# EasyEDA Pro project Chessboards.epro, board Diagonal (continued)
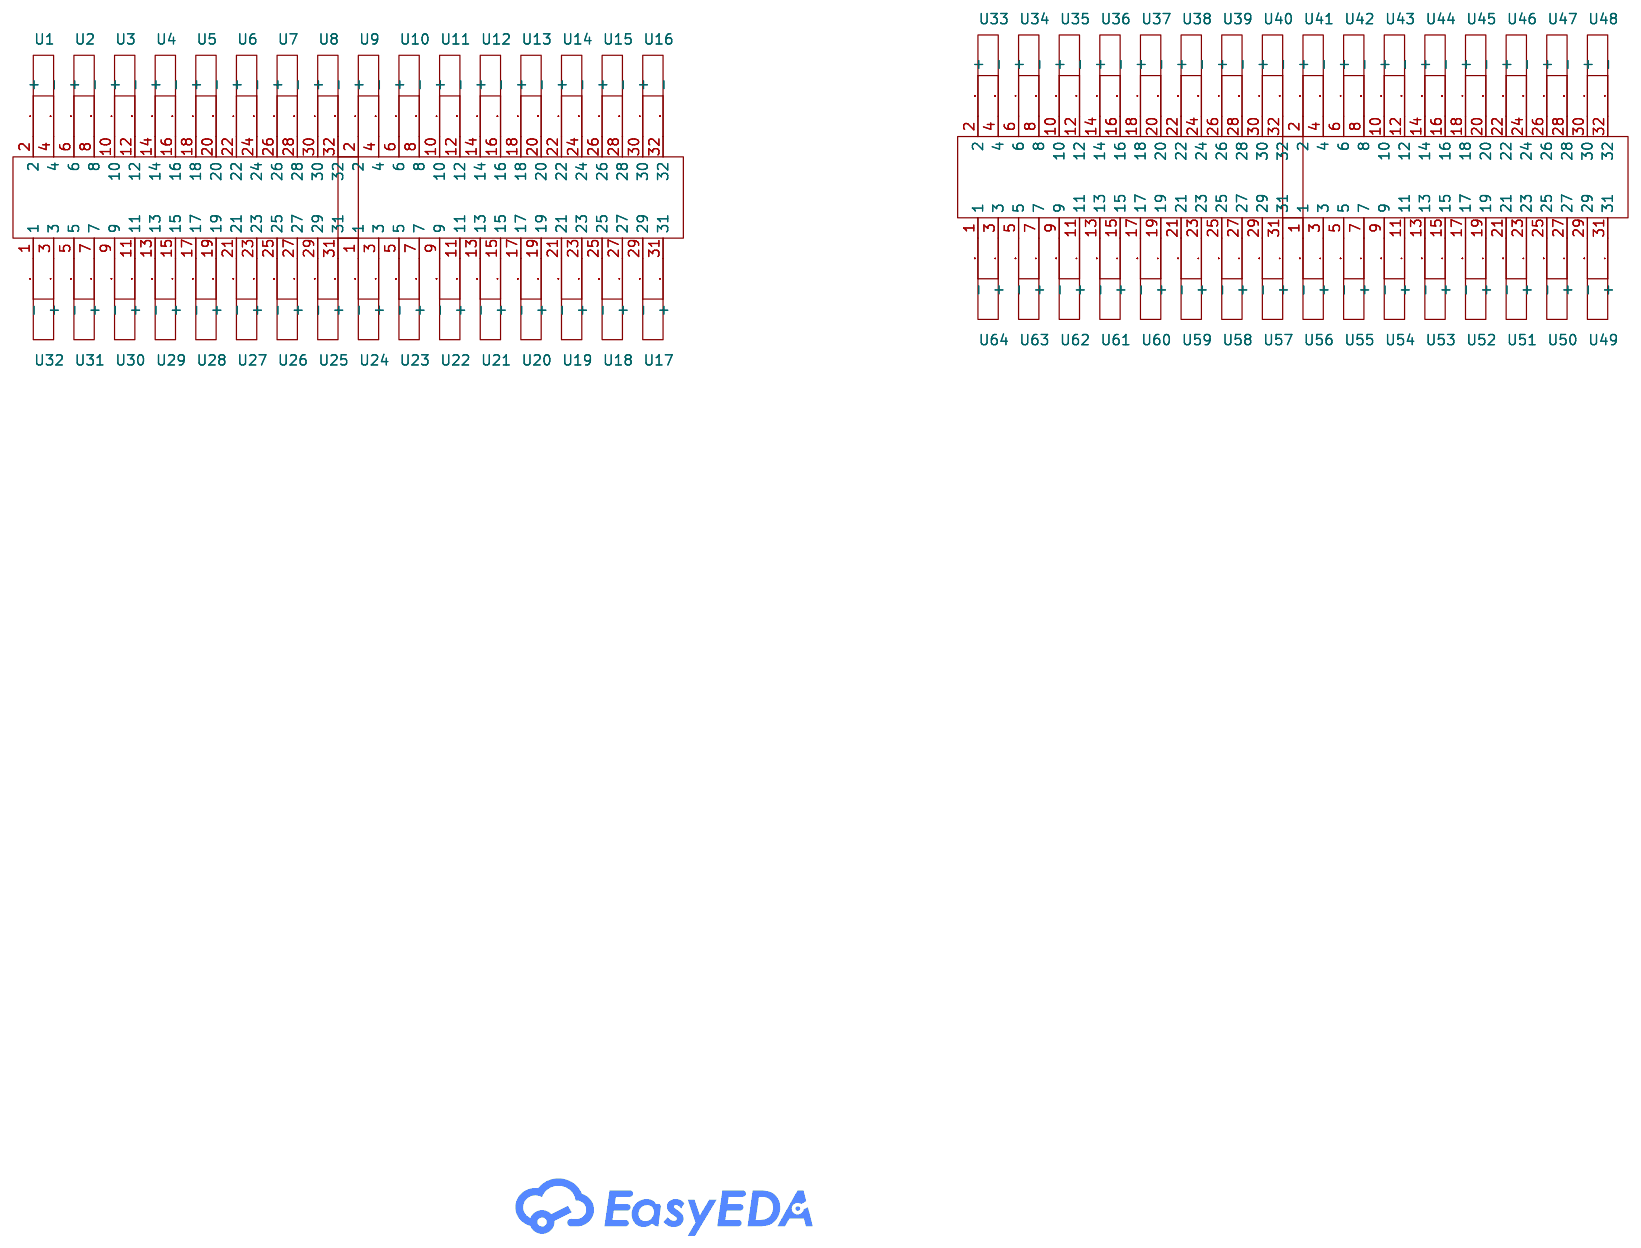
[diagram p0: schematic sheet]
## Routing (per net, layer and track width the routed paths; a pad name or vN(x,y) marks a point on that pad's centre or on a via; arc(x,y) is an arc through that point) (continued)
412.27,442.48 ; 416.19,439.27 416.19,413.4 421.02,408.57 U5.33 ; 416.19,439.27 416.18,444.1 410.8,449.48 408.05,449.48 407.87,449.66 407.87,462.45 414.75,469.33 414.75,469.89 ; 416.19,439.27 416.19,440.99 ; 414.77,439.27 414.77,440.99 ; 414.77,439.27 414.77,410.82 417.02,408.57 U5.41 ; 414.77,439.27 414.76,443.51 410.21,448.06 407.46,448.06 406.44,449.07 406.44,466.12 409.65,469.33 409.65,469.89 ; 372.15,429.09 372.15,412.11 368.61,408.57 U5.91 ; 365.45,37.91 365.45,50.74 364.48,51.71 364.48,52.21 ; 148.56,469.9 148.56,442.02 148.1,441.56 148.1,433.95 146.26,432.1 141.63,432.1 137.71,428.19 ; 294.36,10.19 294.36,24.82 296.66,27.12 296.66,32.44 294.75,34.35 289.67,34.35 286.26,37.76 ; 157.48,469.9 157.48,442.02 150.6,435.13 150.6,432.92 147.29,429.61 142.66,429.61 140.21,427.16 ; v2(83.62,10.22) 83.62,26.9 82.25,28.27 82.25,35.41 83.68,36.84 86.45,36.84 90.61,41 ; v2(248.12,469.85) 248.12,469.29 247.66,468.83 247.66,448.58 249.3,446.94 252.06,446.94 255.98,443.03 255.99,439.22 ; 126.8,37.02 131.25,32.57 136.33,32.57 137.07,31.83 137.07,31.58 130.31,24.82 130.31,10.19 ; U5.47 414.02,408.57 413.7,408.89 413.7,439.27 ; 363.67,37.17 367.91,32.93 372.99,32.93 374.06,31.85 374.06,30.79 368.1,24.82 v2(368.1,10.19) ; v2(82.79,469.85) 82.79,469.29 87.84,464.24 87.84,447.7 90.73,444.81 93.49,444.81 96.16,442.14 ; 373.94,428.36 378.06,432.48 382.69,432.48 384.33,434.12 384.33,441.58 383.87,442.04 383.87,469.92 ; v2(219.79,469.88) 219.79,441.99 224.84,436.94 224.84,434.81 224.24,434.21 219.61,434.21 214.44,429.05 ; 105.62,408.02 105.62,408.52 100.79,413.35 100.79,439.22 ; U5.93 367.61,408.57 371.8,412.75 371.8,429.24 ; v2(55.29,10.19) 55.29,24.82 59.42,28.95 59.42,32.15 57.93,33.64 52.85,33.64 49.02,37.46 49.03,48.81 46.13,51.71 v1(46.13,52.21) ; 247.25,52.19 247.25,51.68 247.57,51.36 247.57,41.27 ; 251.25,52.19 251.25,51.68 248.99,49.43 248.99,40.68 ; 169.41,52.21 169.41,51.71 169.09,51.39 169.09,41.15 ; 91.67,40.56 91.67,48.81 94.56,51.71 94.56,52.21 ; v2(85.34,469.85) 85.34,469.29 88.55,466.08 88.55,447.99 91.03,445.52 93.79,445.52 96.87,442.44 ; 127.51,37.32 127.51,48.17 123.97,51.71 123.97,52.21 ; 240.03,10.19 240.03,26.87 239.57,27.33 239.57,35.53 241.21,37.17 243.98,37.17 247.94,41.12 ; 223.17,10.16 223.17,24.8 219.95,28.01 219.95,33.3 216.79,36.46 211.71,36.46 209.56,38.62 ; 156.1,10.22 156.1,26.9 159.31,30.11 159.31,36.14 161.78,38.62 164.55,38.62 167.66,41.73 ; 171.44,408.04 171.44,408.55 174.98,412.09 174.98,442.17 ; v2(68.03,10.19) 68.03,24.82 62.98,29.87 62.98,33.62 59.4,37.2 54.32,37.2 52.58,38.94 52.59,48.17 56.13,51.71 U3.27 ; 145.03,408.04 145.03,408.55 140.2,413.38 140.2,427.16 ; 176.76,439.25 176.75,442.9 173.04,446.62 170.29,446.62 168.44,448.46 168.44,468.86 167.98,469.31 167.98,469.87 ; 176.76,439.25 176.76,440.97 ; 99.37,439.22 99.36,443.47 94.82,448.01 92.06,448.01 91.05,449.03 91.05,466.08 94.26,469.29 v2(94.26,469.85) ; 99.37,439.22 99.37,410.78 101.62,408.52 101.62,408.02 ; 99.37,439.22 99.37,440.94 ; 60.67,427.43 60.67,412.06 64.22,408.52 U2.101 ; 143.47,469.9 143.47,442.02 146.68,438.8 146.68,434.54 145.67,433.53 141.04,433.53 136.29,428.78 ; 415.12,439.27 415.12,411.47 418.02,408.57 U5.39 ; 415.12,439.27 415.12,440.99 ; 415.12,439.27 415.11,443.66 410.36,448.41 407.6,448.41 406.8,449.22 406.8,465.2 410.93,469.33 410.93,469.89 ; 179.61,439.25 179.6,444.08 174.22,449.46 171.47,449.46 171.29,449.64 171.29,462.43 178.17,469.31 178.17,469.87 ; 179.61,439.25 179.61,413.38 184.44,408.55 184.44,408.04 ; 179.61,439.25 179.61,440.97 ; 99.01,439.22 99.01,440.94 ; 99.01,439.22 99.01,443.32 94.67,447.66 91.91,447.66 90.69,448.88 90.69,466.99 92.98,469.29 v2(92.98,469.85) ; v2(217.24,469.88) 217.24,441.99 224,435.23 224,434.98 223.94,434.93 219.32,434.93 213.73,429.34 ; 253.48,441.99 251.03,444.45 248.27,444.45 245.17,447.55 245.17,463.32 239.2,469.29 v2(239.2,469.85) ; 415.83,439.27 415.83,440.99 ; 415.83,439.27 415.83,443.96 410.66,449.13 407.9,449.13 407.51,449.51 407.51,463.37 413.48,469.33 413.48,469.89 ; 374.29,428.21 374.29,408.89 374.61,408.57 U5.79 ; 257.41,439.22 257.41,440.94 ; 257.41,439.22 257.4,443.62 252.65,448.37 249.89,448.37 249.08,449.17 249.08,465.16 253.22,469.29 v2(253.22,469.85) ; 257.41,439.22 257.41,411.42 260.31,408.52 U1.71 ; 140.03,408.04 140.03,408.55 138.42,410.16 138.42,427.89 ; 173.44,408.04 173.44,408.55 175.69,410.8 175.69,442.46 ; v2(244.3,469.85) 244.3,469.29 246.59,466.99 246.59,448.14 248.86,445.88 251.62,445.88 254.91,442.58 ; 206.71,37.44 210.53,33.61 215.61,33.61 217.1,32.12 217.1,28.93 212.97,24.8 212.97,10.16 ; 88.11,42.02 88.12,42.03 ; 88.11,42.02 88.11,48.17 84.56,51.71 84.56,52.21 ; 88.11,42.02 85.41,39.33 82.64,39.33 79.75,36.44 79.75,31.94 74.71,26.9 v2(74.71,10.22) ; 212.81,52.19 212.81,51.68 209.91,48.78 209.91,38.76 ; 324.63,42.02 321.94,39.33 319.17,39.33 316.28,36.44 316.28,31.94 311.23,26.9 311.23,10.22 ; 324.63,42.02 324.63,48.17 321.09,51.71 321.09,52.21 ; 324.63,42.02 324.64,42.03 ; 308.68,10.22 308.68,26.9 315.57,33.78 315.57,36.73 318.88,40.04 321.65,40.04 323.92,42.31 ; 452.04,10.19 452.04,24.82 454.33,27.12 454.33,32.44 452.42,34.35 447.34,34.35 443.93,37.76 ; 372.87,428.8 377.62,433.55 382.25,433.55 383.26,434.56 383.26,438.82 380.05,442.04 380.05,469.92 ; 373.58,428.5 373.58,409.53 372.61,408.57 U5.83 ; 415.48,439.27 415.47,443.81 410.51,448.77 407.75,448.77 407.15,449.37 407.15,464.28 412.2,469.33 412.2,469.89 ; 415.48,439.27 415.48,440.99 ; 415.48,439.27 415.48,412.11 419.02,408.57 U5.37 ; 59.61,427.87 63.11,431.37 67.74,431.37 70,433.63 70,439.7 72.3,441.99 v2(72.3,469.88) ; U1.47 295.72,408.52 295.39,408.84 295.39,428.16 ; 399.46,469.89 399.46,469.33 403.59,465.2 403.59,447.89 406.28,445.21 409.03,445.21 411.91,442.33 ; 374.95,469.92 374.95,442.04 381.71,435.28 381.71,435.02 381.66,434.97 377.03,434.97 371.45,429.39 ; 249.35,40.53 249.35,48.78 252.25,51.68 252.25,52.19 ; U2.119 55.22,408.52 57.47,410.78 57.47,428.75 ; v1(451.33,52.21) 451.33,51.71 447.14,47.52 447.14,39.09 ; 221.89,10.16 221.89,24.8 219.6,27.09 219.6,33.15 216.65,36.11 211.56,36.11 209.2,38.47 ; v1(91.62,408.02) 91.62,408.52 95.81,412.71 95.81,441.99 ; 328.09,52.21 328.09,51.71 327.12,50.74 327.12,41 ; 122.97,52.21 122.97,51.71 127.16,47.52 127.16,37.17 ; 127.51,37.32 131.55,33.28 136.63,33.28 137.91,32 137.91,29.87 132.86,24.82 132.86,10.19 ; 209.81,52.19 209.81,51.68 208.85,50.72 208.85,38.32 ; 248.65,40.83 244.28,36.45 241.51,36.45 240.29,35.23 240.29,29.16 242.58,26.87 242.58,10.19 ; v1(52.22,408.02) 52.22,408.52 56.4,412.71 56.4,429.19 ; 98.66,439.22 98.66,440.94 ; 98.66,439.22 98.65,443.17 94.52,447.3 91.76,447.3 90.33,448.73 90.33,467.91 91.71,469.29 v2(91.71,469.85) ; 98.66,439.22 98.66,409.49 99.62,408.52 99.62,408.02 ; v2(237.93,469.85) 237.93,469.29 244.81,462.4 244.81,447.4 248.12,444.1 250.88,444.1 253.13,441.85 ; 410.84,441.89 408.59,444.14 405.83,444.14 402.53,447.45 402.53,462.45 395.64,469.33 395.64,469.89 ; v2(60.39,10.19) 60.39,24.82 60.84,25.28 60.84,32.74 58.52,35.06 53.44,35.06 50.45,38.05 50.45,51.39 50.13,51.71 U3.15 ; v2(64.65,469.88) 64.65,441.99 67.86,438.78 67.86,434.52 66.85,433.5 62.22,433.5 57.47,428.75 ; 125.97,52.21 125.97,51.71 128.23,49.45 128.23,37.61 ; 371.44,429.39 371.44,413.4 366.61,408.57 U5.95 ; 85.56,52.21 85.56,51.71 88.46,48.81 88.46,41.87 ; 216.58,428.16 220.5,432.08 225.12,432.08 226.97,433.93 226.97,441.53 227.43,441.99 v2(227.43,469.88) ; 144.74,469.9 144.74,442.02 147.04,439.72 147.04,434.39 145.81,433.17 141.19,433.17 136.65,428.63 ; 243.85,10.19 243.85,26.87 240.64,30.08 240.64,35.08 241.66,36.1 244.43,36.1 249,40.68 ; 337.29,439.22 337.29,413.35 342.12,408.52 342.12,408.02 ; 337.29,439.22 337.29,440.94 ; 59.96,427.72 59.96,410.78 62.22,408.52 U2.105 ; 322.7,10.22 322.7,26.9 319.49,30.11 319.49,35.11 320.5,36.12 323.27,36.12 327.85,40.7 ; 162.88,469.87 162.88,469.31 167.01,465.18 167.01,447.87 169.7,445.19 172.45,445.19 175.33,442.31 ; v1(450.33,52.21) 450.33,51.71 446.78,48.17 446.78,38.94 ; 304.97,469.88 304.97,441.99 305.43,441.53 305.43,434.07 303.79,432.43 299.17,432.43 295.04,428.31 ; v2(371.92,10.19) 371.92,24.82 375.13,28.03 375.13,32.3 373.43,34 368.35,34 364.73,37.61 ; 169.25,469.87 169.25,469.31 168.79,468.86 168.79,448.61 170.43,446.97 173.19,446.97 177.11,443.05 177.12,439.25 ; 255.99,439.22 255.99,408.84 256.31,408.52 U1.79 ; 255.99,439.22 255.99,440.94 ; 363.48,52.21 363.48,51.71 365.09,50.1 365.09,37.76 ; 385.14,469.92 385.14,442.04 384.68,441.58 384.68,433.97 382.84,432.12 378.21,432.12 374.29,428.21 ; U1.41 298.72,408.52 296.46,410.78 296.46,427.72 ; 454.56,427.61 457.64,430.7 462.26,430.7 464.95,433.38 464.95,437.9 469.08,442.03 469.08,469.92 ; 450.28,429.38 455.87,434.97 460.5,434.97 460.55,435.02 460.55,435.27 453.79,442.03 453.79,469.92 ; 168.02,41.58 168.03,41.59 ; 168.02,41.58 164.7,38.26 161.93,38.26 159.67,36 159.67,29.19 157.37,26.9 157.37,10.22 ; 364.74,37.61 364.74,49.45 362.48,51.71 362.48,52.21 ; 94.62,408.02 94.62,408.52 96.88,410.78 96.88,442.44 ; 149.42,10.19 149.42,24.82 142.54,31.71 142.54,33.92 138.54,37.91 133.46,37.91 132.14,39.23 ; 413.7,439.27 413.7,440.99 ; 413.7,439.27 413.69,443.07 409.77,446.99 407.01,446.99 405.37,448.63 405.37,468.88 405.83,469.33 405.83,469.89 ; 218.72,427.28 221.38,429.94 226.01,429.94 229.11,433.04 229.11,436.02 235.07,441.99 v2(235.07,469.88) ; 135.41,10.19 135.41,24.82 138.62,28.03 138.62,32.3 136.92,34 131.84,34 128.22,37.61 ; 313.89,469.88 313.89,441.99 307.92,436.02 307.92,433.04 304.82,429.94 300.2,429.94 297.53,427.28 ; 61.03,427.28 61.03,412.71 65.22,408.52 U2.99 ; 168.84,10.22 168.84,26.9 162.87,32.86 162.87,34.67 163.26,35.06 166.03,35.06 171.23,40.26 ; 217.29,427.87 217.29,410.13 218.9,408.52 U1.107 ; 181.44,408.04 181.44,408.55 178.54,411.45 178.54,439.25 ; 376.07,427.47 378.95,430.34 383.57,430.34 386.46,433.24 386.46,436.99 391.51,442.04 391.51,469.92 ; v1(250.31,408.02) 250.31,408.52 253.85,412.06 253.85,442.14 ; 458.45,408.06 458.45,408.56 454.91,412.11 454.91,427.47 ; 129.65,38.2 129.65,51.39 129.97,51.71 129.97,52.21 ; 171.58,40.11 171.58,46.88 176.41,51.71 176.41,52.21 ; 166.24,42.31 166.24,46.88 161.41,51.71 161.41,52.21 ; 166.24,42.31 166.25,42.33 ; v1(292.66,52.21) 292.66,51.71 289.11,48.17 289.11,38.94 ; 456.45,408.06 456.45,408.56 454.2,410.82 454.2,427.76 ; 147.29,469.9 147.29,442.02 147.75,441.56 147.75,434.1 146.11,432.46 141.48,432.46 137.36,428.34 ; 307.1,10.19 307.1,24.82 300.22,31.71 300.22,33.92 296.23,37.91 291.15,37.91 289.82,39.23 ; 333.37,442.44 330.28,445.52 327.53,445.52 325.05,447.99 325.05,466.08 321.84,469.29 321.84,469.85 ; 91.31,40.7 91.31,49.45 93.56,51.71 93.56,52.21 ; 139.49,427.45 142.37,430.32 146.99,430.32 149.88,433.21 149.88,436.97 154.93,442.02 154.93,469.9 ; 96.51,442.29 93.64,445.16 90.88,445.16 88.2,447.85 88.2,465.16 84.07,469.29 v2(84.07,469.85) ; 408.09,40.11 408.09,46.88 412.92,51.71 U6.63 ; 376.43,427.32 376.43,412.75 380.61,408.57 U5.67 ; 95.45,441.85 93.2,444.1 90.44,444.1 87.13,447.4 87.13,462.4 80.24,469.29 v2(80.24,469.85) ; 139.85,427.3 139.85,412.73 144.03,408.55 144.03,408.04 ; 160.33,469.87 160.33,469.31 166.3,463.35 166.3,447.58 169.4,444.48 172.16,444.48 174.62,442.02 ; 294.33,428.61 298.87,433.15 303.5,433.15 304.72,434.37 304.72,439.7 302.42,441.99 302.42,469.88 ; 288.75,38.79 290.7,36.84 295.78,36.84 299.15,33.48 299.15,28.95 303.28,24.82 303.28,10.19 ; 443.58,37.61 443.58,49.45 441.33,51.71 U6.73 ; 445.72,38.5 445.72,50.1 447.33,51.71 U6.85 ; 375,427.91 375,410.18 376.61,408.57 U5.75 ; 326.06,41.43 326.06,50.74 325.09,51.71 325.09,52.21 ; 326.06,41.43 326.07,41.44 ; 326.06,41.43 326.06,41.4 ; 326.06,41.43 322.53,37.9 319.76,37.9 317.71,35.85 317.71,28.27 316.33,26.9 316.33,10.22 ; 373.22,428.65 373.22,410.18 371.61,408.57 U5.85 ; 285.91,37.61 285.91,49.45 283.66,51.71 U4.73 ; 324.99,41.87 324.99,48.81 322.09,51.71 322.09,52.21 ; 324.99,41.87 322.09,38.97 319.32,38.97 316.64,36.29 316.64,31.03 312.51,26.9 312.51,10.22 ; 324.99,41.87 325,41.88 ; U6.83 446.33,51.71 445.36,50.74 445.36,38.35 ; 286.62,37.91 289.82,34.71 294.9,34.71 297.02,32.59 297.02,26.2 295.64,24.82 295.64,10.19 ; 210.98,39.21 212.3,37.89 217.38,37.89 221.38,33.89 221.38,31.68 228.26,24.8 228.26,10.16 ; 324.28,42.17 321.79,39.69 319.02,39.69 315.93,36.59 315.93,32.86 309.96,26.9 309.96,10.22 ; 324.28,42.17 324.29,42.18 ; 323.92,42.31 323.93,42.33 ; 323.92,42.31 323.92,46.88 319.09,51.71 319.09,52.21 ; 141.03,408.04 141.03,408.55 138.78,410.8 138.78,427.75 ; 96.62,408.02 96.62,408.52 97.59,409.49 97.59,439.22 ; 234.94,10.19 234.94,26.87 238.15,30.08 238.15,36.12 240.62,38.59 243.39,38.59 246.5,41.7 ; v2(62.93,10.19) 62.93,24.82 61.56,26.2 61.56,33.03 58.81,35.78 53.73,35.78 51.16,38.35 51.16,50.74 52.13,51.71 U3.19 ; 95.8,441.99 93.34,444.45 90.58,444.45 87.49,447.55 87.49,463.32 81.52,469.29 v2(81.52,469.85) ; 471.63,469.92 471.63,442.03 465.66,436.07 465.66,433.08 462.56,429.98 457.93,429.98 455.27,427.32 ; U6.51 406.92,51.71 405.95,50.74 405.95,41 ; 250.25,52.19 250.25,51.68 248.64,50.07 248.64,40.83 ; 208.49,38.18 211.27,35.39 216.35,35.39 218.88,32.86 218.88,25.25 219.34,24.8 219.34,10.16 ; 141.78,10.19 141.78,24.82 140.4,26.2 140.4,33.03 137.66,35.78 132.58,35.78 130,38.35 ; v2(62.1,469.88) 62.1,441.99 67.15,436.94 67.15,434.81 66.56,434.21 61.93,434.21 56.76,429.05 ; 169.81,40.85 165.44,36.48 162.67,36.48 161.45,35.26 161.45,29.19 163.74,26.9 163.74,10.22 ; v2(222.33,469.88) 222.33,441.99 225.55,438.78 225.55,434.52 224.53,433.5 219.91,433.5 215.16,428.75 ; 452.06,428.65 452.06,410.17 450.45,408.56 450.45,408.06 ; 388.97,469.92 388.97,442.04 385.75,438.82 385.75,433.53 383.28,431.06 378.65,431.06 375.36,427.77 ; 453.13,428.2 453.13,408.88 453.45,408.56 453.45,408.06 ; 92.75,40.11 87.33,34.7 84.56,34.7 84.38,34.52 84.38,33.78 91.27,26.9 v2(91.27,10.22) ; 334.8,439.22 334.8,408.84 335.12,408.52 335.12,408.02 ; 334.8,439.22 334.8,440.94 ; 334.8,439.22 334.79,443.03 330.87,446.94 328.12,446.94 326.48,448.58 326.48,468.83 326.94,469.29 326.94,469.85 ; 226.99,10.16 226.99,24.8 221.02,30.76 221.02,33.74 217.24,37.53 212.15,37.53 210.62,39.06 ; 242.25,52.19 242.25,51.68 245.79,48.14 245.79,41.99 ; v2(68.47,469.88) 68.47,441.99 68.93,441.53 68.93,434.07 67.29,432.43 62.67,432.43 58.54,428.31 ; 177.47,439.25 177.47,409.51 178.44,408.55 178.44,408.04 ; 177.47,439.25 177.47,443.2 173.34,447.33 170.58,447.33 169.15,448.76 169.15,467.94 170.53,469.31 170.53,469.87 ; 177.47,439.25 177.47,440.97 ; 448.21,10.19 448.21,24.82 453.26,29.87 453.26,32 451.98,33.28 446.9,33.28 442.87,37.32 ; 206.35,37.29 206.35,48.14 202.81,51.68 202.81,52.19 ; 219.07,427.13 219.07,413.35 223.9,408.52 U1.97 ; 452.77,428.35 452.77,408.88 452.45,408.56 452.45,408.06 ; 153.66,469.9 153.66,442.02 149.53,437.89 149.53,433.36 146.85,430.68 142.22,430.68 139.14,427.6 ; U4.77 285.66,51.71 286.62,50.74 286.62,37.91 ; 327.49,40.85 323.12,36.48 320.35,36.48 319.13,35.26 319.13,29.19 321.42,26.9 321.42,10.22 ; 131.03,408.04 131.03,408.55 135.22,412.73 135.22,429.22 ; 216.22,428.31 216.22,408.84 215.9,408.52 U1.113 ; 174.41,52.21 174.41,51.71 170.87,48.17 170.87,40.41 ; 250.06,40.24 250.06,47.5 254.25,51.68 254.25,52.19 ; v1(211.9,408.02) 211.9,408.52 214.8,411.42 214.8,428.9 ; 250.07,40.24 244.87,35.03 242.1,35.03 241.71,34.64 241.71,32.84 247.68,26.87 247.68,10.19 ; 164.16,469.87 164.16,469.31 167.37,466.1 167.37,448.02 169.84,445.55 172.6,445.55 175.69,442.46 ; 334.09,439.22 334.08,442.73 330.58,446.23 327.82,446.23 325.76,448.29 325.76,467.91 324.39,469.29 324.39,469.85 ; 334.09,439.22 334.09,409.49 333.12,408.52 333.12,408.02 ; 334.09,439.22 334.09,440.94 ; 405.24,41.29 405.24,51.39 404.92,51.71 U6.47 ; 411.92,442.33 411.92,411.47 409.02,408.57 U5.57 ; 288.4,38.64 288.4,49.45 290.66,51.71 U4.87 ; 452.78,428.35 456.9,432.48 461.53,432.48 463.17,434.12 463.17,441.57 462.71,442.03 462.71,469.92 ; 331.95,441.85 331.95,413.35 327.12,408.52 v1(327.12,408.02) ; v2(78.67,469.88) 78.67,441.99 71.78,435.11 71.78,432.89 68.47,429.59 63.85,429.59 61.39,427.13 ; 138.07,428.04 138.07,409.51 139.03,408.55 139.03,408.04 ; 402.01,469.89 402.01,469.33 404.31,467.04 404.31,448.19 406.57,445.92 409.33,445.92 412.62,442.63 ; 287.69,38.35 290.26,35.78 295.34,35.78 298.08,33.03 298.08,26.2 299.46,24.82 299.46,10.19 ; 245.79,41.99 243.1,39.3 240.33,39.3 237.44,36.41 237.44,31.92 232.39,26.87 232.39,10.19 ; 245.79,41.99 245.8,42.01 ; 299.88,469.88 299.88,441.99 304.01,437.86 304.01,434.66 303.2,433.86 298.58,433.86 293.62,428.9 ; U1.53 292.72,408.52 294.33,410.13 294.33,428.61 ; 465.26,469.92 465.26,442.03 463.88,440.66 463.88,433.82 461.82,431.76 457.2,431.76 453.49,428.06 ; 247.21,41.4 247.21,41.37 ; 247.21,41.4 247.21,50.72 246.25,51.68 246.25,52.19 ; 247.21,41.4 243.69,37.88 240.92,37.88 238.86,35.82 238.86,28.25 237.48,26.87 237.48,10.19 ; 247.21,41.4 247.22,41.42 ; 250.43,40.09 245.02,34.68 242.25,34.68 242.07,34.5 242.07,33.75 248.95,26.87 248.95,10.19 ; 411.21,442.04 411.21,412.75 407.02,408.57 U5.61 ; U5.73 377.61,408.57 375.36,410.82 375.36,427.77 ; U4.75 284.66,51.71 286.27,50.1 286.27,37.76 ; 130.72,38.64 132.87,36.49 137.95,36.49 141.11,33.33 141.11,28.03 144.33,24.82 144.33,10.19 ; 364.38,37.46 368.2,33.64 373.28,33.64 374.77,32.15 374.77,28.95 370.64,24.82 v2(370.64,10.19) ; U5.43 416.02,408.57 414.41,410.18 414.41,439.27 ; U1.67 262.31,408.52 258.12,412.71 258.12,439.22 ; 413.34,439.27 413.34,408.89 413.02,408.57 U5.49 ; 413.34,439.27 413.34,440.99 ; 413.34,439.27 413.33,442.92 409.62,446.63 406.87,446.63 405.02,448.48 405.02,468.88 404.56,469.33 404.56,469.89 ; 297.33,469.88 297.33,441.99 303.3,436.02 303.3,434.96 302.91,434.57 298.28,434.57 292.9,429.19 ; 218.07,10.16 218.07,24.8 218.53,25.25 218.53,32.71 216.2,35.04 211.12,35.04 208.13,38.03 ; 100.79,439.22 100.79,444.06 95.41,449.44 92.65,449.44 92.47,449.62 92.47,462.4 99.35,469.29 v2(99.35,469.85) ; 100.79,439.22 100.79,440.94 ; 215.52,10.16 215.52,24.8 217.82,27.09 217.82,32.42 215.91,34.33 210.83,34.33 207.42,37.73 ; 284.49,37.02 284.49,46.88 279.66,51.71 U4.65 ; 451.45,408.06 451.45,408.56 452.42,409.53 452.42,428.5 ; U5.87 370.61,408.57 372.87,410.82 372.87,428.8 ; 454.45,408.06 454.45,408.56 453.49,409.53 453.49,428.06 ; v2(233.8,469.88) 233.8,441.99 228.75,436.94 228.75,433.19 225.86,430.3 221.23,430.3 218.36,427.43 ; 447.49,39.23 448.82,37.91 453.9,37.91 457.89,33.92 457.89,31.71 464.78,24.82 464.78,10.19 ; U1.115 214.9,408.52 215.87,409.49 215.87,428.46 ; 333.09,52.21 333.09,51.71 328.9,47.52 328.9,40.26 ; 399.01,10.25 v2(398.98,10.22) 398.98,26.9 397.6,28.27 397.6,35.41 399.03,36.84 401.8,36.84 405.96,41 ; 152.38,469.9 152.38,442.02 149.17,438.8 149.17,433.51 146.7,431.04 142.07,431.04 138.78,427.75 ; v2(232.53,469.88) 232.53,441.99 228.4,437.86 228.4,433.34 225.71,430.65 221.09,430.65 218,427.57 ; 89.89,41.29 89.89,51.39 89.56,51.71 89.56,52.21 ; 472.9,469.92 472.9,442.03 466.01,435.15 466.01,432.94 462.71,429.63 458.08,429.63 455.62,427.17 ; 255.27,439.22 255.27,409.49 254.31,408.52 U1.83 ; 255.27,439.22 255.26,442.73 251.76,446.23 249,446.23 246.95,448.29 246.95,467.91 245.57,469.29 v2(245.57,469.85) ; 255.27,439.22 255.27,440.94 ; 320.57,469.85 320.57,469.29 324.7,465.16 324.7,447.85 327.38,445.16 330.14,445.16 333.01,442.29 ; 90.56,52.21 90.56,51.71 90.24,51.39 90.24,41.15 ; v1(330.12,408.02) 330.12,408.52 333.02,411.42 333.02,442.29 ; 446.94,10.19 446.94,24.82 452.91,30.79 452.91,31.85 451.83,32.93 446.75,32.93 442.51,37.17 ; v2(75.98,10.22) 75.98,26.9 80.11,31.03 80.11,36.29 82.79,38.97 85.56,38.97 88.46,41.87 ; 167.66,41.73 167.66,49.45 165.41,51.71 165.41,52.21 ; 167.66,41.73 167.67,41.74 ; 57.83,428.61 57.83,410.13 56.22,408.52 U2.117 ; 170.58,469.82 v2(170.55,469.85) ; 138.03,408.04 138.03,408.55 137.71,408.87 137.71,428.19 ; U5.45 415.02,408.57 414.05,409.53 414.05,439.27 ; 318.02,469.85 318.02,469.29 323.99,463.32 323.99,447.55 327.08,444.45 329.84,444.45 332.3,441.99 ; 302.01,10.19 302.01,24.82 298.8,28.03 298.8,33.33 295.64,36.49 290.56,36.49 288.4,38.64 ; 304.56,10.19 304.56,24.82 299.51,29.87 299.51,33.62 295.93,37.2 290.85,37.2 289.11,38.94 ; 367.94,38.94 369.68,37.2 374.76,37.2 378.34,33.62 378.34,29.87 383.38,24.82 v2(383.38,10.19) ; 450.76,10.19 450.76,24.82 453.97,28.03 453.97,32.3 452.27,34 447.19,34 443.58,37.61 ; 178.54,439.25 178.54,440.97 ; v1(92.62,408.02) 92.62,408.52 96.17,412.06 96.17,442.14 ; 216.8,10.16 216.8,24.8 218.17,26.17 218.17,32.56 216.06,34.68 210.97,34.68 207.78,37.88 ; 244.25,52.19 244.25,51.68 246.5,49.43 246.5,41.7 ; 215.81,52.19 215.81,51.68 210.98,46.85 210.98,39.21 ; 176.04,442.61 172.75,445.9 169.99,445.9 167.73,448.17 167.73,467.02 165.43,469.31 165.43,469.87 ; 210.27,38.91 212.01,37.17 217.09,37.17 220.66,33.6 220.66,29.84 225.71,24.8 225.71,10.16 ; 206.81,52.19 206.81,51.68 207.78,50.72 207.78,37.88 ; U1.37 300.72,408.52 297.17,412.06 297.17,427.43 ; 256.7,439.22 256.7,410.13 258.31,408.52 U1.75 ; 256.7,439.22 256.69,443.32 252.35,447.66 249.59,447.66 248.37,448.88 248.37,466.99 250.67,469.29 v2(250.67,469.85) ; 256.7,439.22 256.7,440.94 ; 293.97,428.75 298.72,433.5 303.35,433.5 304.36,434.52 304.36,438.78 301.15,441.99 301.15,469.88 ; v2(63.38,469.88) 63.38,441.99 67.51,437.86 67.51,434.66 66.7,433.86 62.08,433.86 57.12,428.9 ; 443.22,37.46 443.22,48.81 440.33,51.71 U6.71 ; 92.39,40.26 87.18,35.06 84.41,35.06 84.03,34.67 84.03,32.86 89.99,26.9 v2(89.99,10.22) ; U1.109 217.9,408.52 216.93,409.49 216.93,428.01 ; 455.06,469.92 455.06,442.03 461.03,436.07 461.03,435 460.64,434.61 456.02,434.61 450.64,429.24 ; 213.73,429.34 213.73,413.35 208.9,408.52 v1(208.9,408.02) ; 92.02,40.41 92.02,48.17 95.56,51.71 95.56,52.21 ; 246.5,41.7 246.51,41.71 ; v2(65.93,469.88) 65.93,441.99 68.22,439.7 68.22,434.37 67,433.15 62.37,433.15 57.83,428.61 ; 59.25,428.01 59.25,409.49 60.22,408.52 U2.109 ; 414.05,439.27 414.05,440.99 ; 139.85,427.3 142.51,429.97 147.14,429.97 150.24,433.07 150.24,436.05 156.21,442.02 156.21,469.9 ; 376.43,427.32 379.09,429.99 383.72,429.99 386.82,433.09 386.82,436.07 392.79,442.04 392.79,469.92 ; 95.45,441.85 95.45,413.35 90.62,408.52 v1(90.62,408.02) ; 329.27,40.11 323.86,34.7 321.09,34.7 320.91,34.52 320.91,33.78 327.79,26.9 327.79,10.22 ; 444.65,38.05 444.65,51.39 444.33,51.71 U6.79 ; 312.62,469.88 312.62,441.99 307.57,436.94 307.57,433.19 304.68,430.3 300.05,430.3 297.18,427.43 ; v1(44.13,52.21) 44.13,51.71 48.31,47.52 48.31,37.17 52.55,32.93 57.63,32.93 58.71,31.85 58.71,30.79 52.74,24.82 v2(52.74,10.19) ; 323.97,10.22 323.97,26.9 319.84,31.03 319.84,34.96 320.65,35.77 323.42,35.77 328.2,40.56 ; 294.68,428.46 299.02,432.79 303.64,432.79 305.08,434.22 305.08,440.61 303.7,441.99 303.7,469.88 ; U3.13 49.13,51.71 50.09,50.74 50.09,37.91 53.29,34.71 58.37,34.71 60.49,32.59 60.49,26.2 59.11,24.82 v2(59.11,10.19) ; v2(56.56,10.19) 56.56,24.82 59.78,28.03 59.78,32.3 58.08,34 53,34 49.38,37.61 49.38,49.45 47.13,51.71 U3.9 ; 214.44,429.05 214.44,412.06 210.9,408.52 v1(210.9,408.02) ; 443.94,37.76 443.94,50.1 442.33,51.71 U6.75 ; 376.07,427.47 376.07,412.11 379.61,408.57 U5.69 ; 249.71,40.38 249.71,48.14 253.25,51.68 253.25,52.19 ; 179.25,439.25 179.25,443.94 174.08,449.11 171.32,449.11 170.93,449.5 170.93,463.35 176.9,469.31 176.9,469.87 ; 179.25,439.25 179.25,440.97 ; 179.25,439.25 179.25,412.73 183.44,408.55 183.44,408.04 ; U4.71 282.66,51.71 285.55,48.81 285.55,37.46 ; 407.38,40.41 407.38,48.17 410.92,51.71 U6.59 ; 245.43,42.14 245.44,42.15 ; 245.43,42.14 245.43,47.5 241.25,51.68 241.25,52.19 ; 127.87,37.46 131.69,33.64 136.77,33.64 138.26,32.15 138.26,28.95 134.13,24.82 134.13,10.19 ; U5.53 411.02,408.57 412.63,410.18 412.63,442.63 ; U1.45 296.72,408.52 295.75,409.49 295.75,428.01 ; 284.48,37.02 288.93,32.57 294.01,32.57 294.75,31.83 294.75,31.58 287.99,24.82 287.99,10.19 ; 100.44,439.22 100.44,412.71 104.62,408.52 104.62,408.02 ; 100.44,439.22 100.44,440.94 ; 333.73,442.58 333.73,410.13 332.12,408.52 332.12,408.02 ; 411.56,442.19 411.56,412.11 408.02,408.57 U5.59 ; 458.41,10.19 458.41,24.82 456.11,27.12 456.11,33.18 453.16,36.13 448.08,36.13 445.71,38.5 ; v1(289.72,408.02) 289.72,408.52 293.26,412.06 293.26,429.05 ; 454.2,427.76 457.49,431.05 462.12,431.05 464.59,433.53 464.59,438.82 467.8,442.03 467.8,469.92 ; 175.34,442.31 175.34,411.45 172.44,408.55 172.44,408.04 ; 165.01,10.22 165.01,26.9 161.8,30.11 161.8,35.11 162.82,36.12 165.59,36.12 170.17,40.7 ; 92.73,40.11 92.73,46.88 97.56,51.71 97.56,52.21 ; 398.19,469.89 398.19,469.33 403.24,464.28 403.24,447.75 406.13,444.85 408.89,444.85 411.55,442.19 ; 288.04,38.5 290.41,36.13 295.49,36.13 298.44,33.18 298.44,27.12 300.73,24.82 300.73,10.19 ; 214.8,428.9 219.76,433.86 224.39,433.86 225.19,434.66 225.19,437.86 221.06,441.99 v2(221.06,469.88) ; 143.03,408.04 143.03,408.55 139.49,412.09 139.49,427.45 ; 296.05,469.88 296.05,441.99 302.81,435.23 302.81,434.98 302.76,434.93 298.13,434.93 292.55,429.34 ; 209.91,38.76 211.86,36.82 216.94,36.82 220.31,33.45 220.31,28.93 224.44,24.8 224.44,10.16 ; 407.02,40.56 407.02,48.81 409.92,51.71 U6.57 ; v1(93.62,408.02) 93.62,408.52 96.52,411.42 96.52,442.29 ; U5.89 369.61,408.57 372.51,411.47 372.51,428.95 ; 316.74,469.85 316.74,469.29 323.63,462.4 323.63,447.4 326.94,444.1 329.69,444.1 331.94,441.85 ; U3.21 53.13,51.71 51.52,50.1 51.52,38.5 53.88,36.13 58.96,36.13 61.91,33.18 61.91,27.12 64.21,24.82 v2(64.21,10.19) ; 414.41,439.27 414.41,440.99 ; 335.16,439.22 335.16,440.94 ; v2(86.17,10.22) 86.17,26.9 82.96,30.11 82.96,35.11 83.97,36.12 86.74,36.12 91.32,40.7 ; 373.93,428.36 373.93,408.89 373.61,408.57 U5.81 ; 177.12,439.25 177.12,440.97 ; 177.12,439.25 177.12,408.87 177.44,408.55 177.44,408.04 ; U1.35 301.72,408.52 297.53,412.71 297.53,427.28 ; 327.14,41 322.97,36.84 320.2,36.84 318.77,35.41 318.77,28.27 320.15,26.9 320.15,10.22 ; 206.71,37.44 206.71,48.78 203.81,51.68 203.81,52.19 ; 170.11,10.22 170.11,26.9 163.23,33.78 163.23,34.52 163.41,34.7 166.18,34.7 171.59,40.11 ; 442.16,37.02 442.16,46.88 437.33,51.71 U6.65 ; 390.24,469.92 390.24,442.04 386.11,437.91 386.11,433.38 383.43,430.7 378.8,430.7 375.72,427.62 ; 334.58,469.85 334.58,469.29 328.61,463.32 328.61,449.47 329,449.08 331.76,449.08 336.93,443.91 336.94,439.22 ; 444.65,38.05 447.64,35.06 452.72,35.06 455.04,32.74 455.04,25.28 454.58,24.82 454.58,10.19 ; 90.97,40.85 86.59,36.48 83.82,36.48 82.6,35.26 82.6,29.19 84.9,26.9 v2(84.9,10.22) ; 367.94,38.94 367.94,48.17 371.48,51.71 371.48,52.21 ; 327.84,40.7 327.84,49.45 330.09,51.71 330.09,52.21 ; 328.19,40.56 328.19,48.81 331.09,51.71 331.09,52.21 ; 247.58,41.27 243.84,37.52 241.06,37.52 239.22,35.68 239.22,27.33 238.76,26.87 238.76,10.19 ; 90.6,41 90.6,50.74 91.56,51.71 91.56,52.21 ; v1(249.31,408.02) 249.31,408.52 253.49,412.71 253.49,441.99 ; 92.03,40.41 87.04,35.41 84.27,35.41 83.67,34.82 83.67,31.94 88.72,26.9 v2(88.72,10.22) ; 151.11,469.9 151.11,442.02 148.82,439.72 148.82,433.66 146.55,431.39 141.92,431.39 138.43,427.89 ; 405.6,41.15 405.6,51.39 405.92,51.71 U6.49 ; 175.41,52.21 175.41,51.71 171.22,47.52 171.22,40.26 ; v1(54.22,408.02) 54.22,408.52 57.11,411.42 57.11,428.9 ; U4.67 280.66,51.71 284.84,47.52 284.84,37.17 ; 135.93,428.93 135.93,411.45 133.03,408.55 133.03,408.04 ; 457.45,408.06 457.45,408.56 454.55,411.46 454.55,427.61 ; 128.94,37.91 132.13,34.71 137.22,34.71 139.33,32.59 139.33,26.2 137.96,24.82 137.96,10.19 ; U6.87 448.33,51.71 446.07,49.45 446.07,38.64 ; 146.02,469.9 146.02,442.02 147.39,440.64 147.39,434.25 145.96,432.82 141.33,432.82 137,428.48 ; U2.97 66.22,408.52 61.39,413.35 61.39,427.13 ; 131.78,39.09 133.31,37.56 138.4,37.56 142.18,33.77 142.18,30.79 148.15,24.82 148.15,10.19 ; U3.11 48.13,51.71 49.74,50.1 49.74,37.76 53.14,34.35 58.22,34.35 60.13,32.44 60.13,27.12 57.84,24.82 v2(57.84,10.19) ; 207.06,37.59 210.68,33.97 215.76,33.97 217.46,32.27 217.46,28.01 214.25,24.8 214.25,10.16 ; 166.29,10.22 166.29,26.9 162.16,31.03 162.16,34.96 162.96,35.77 165.73,35.77 170.52,40.56 ; 174.44,408.04 174.44,408.55 176.05,410.16 176.05,442.61 ; 130.01,38.35 130.01,50.74 130.97,51.71 130.97,52.21 ; 170.44,408.04 170.44,408.55 174.63,412.73 174.63,442.02 ; 320.16,10.23 320.15,10.22 ; 320.15,10.22 v2(320.12,10.19) ; 131.43,38.94 133.17,37.2 138.25,37.2 141.82,33.62 141.82,29.87 146.87,24.82 146.87,10.19 ; 336.94,439.22 336.94,440.94 ; 336.94,439.22 336.94,412.71 341.12,408.52 341.12,408.02 ; 308.79,469.88 308.79,441.99 306.5,439.7 306.5,433.63 304.23,431.37 299.61,431.37 296.11,427.87 ; 293.97,428.75 293.97,410.78 291.72,408.52 U1.55 ; 168.73,41.29 168.73,51.39 168.41,51.71 168.41,52.21 ; 326.77,41.15 326.77,51.39 327.09,51.71 327.09,52.21 ; v1(287.72,408.02) 287.72,408.52 292.55,413.35 292.55,429.34 ; U5.65 381.61,408.57 376.78,413.4 376.78,427.18 ; 334.09,52.21 334.09,51.71 329.26,46.88 329.26,40.11 ; 169.44,408.04 169.44,408.55 174.27,413.38 174.27,441.87 ; 451,429.09 456.16,434.26 460.79,434.26 461.39,434.85 461.39,436.98 456.34,442.03 456.34,469.92 ; 97.59,439.22 97.59,440.94 ; v2(380.84,10.19) 380.84,24.82 377.62,28.03 377.62,33.33 374.46,36.49 369.38,36.49 367.23,38.64 ; 200.81,52.19 200.81,51.68 205.64,46.85 205.64,37 ; 206,37.14 210.24,32.9 215.32,32.9 216.39,31.83 216.39,30.76 210.43,24.8 210.43,10.16 ; 97.23,442.58 97.23,410.13 95.62,408.52 95.62,408.02 ; 455.45,408.06 455.45,408.56 453.84,410.17 453.84,427.91 ; 127.97,52.21 127.97,51.71 128.94,50.74 128.94,37.91 ; 171.41,52.21 171.41,51.71 169.8,50.1 169.8,40.85 ; 170.88,40.41 165.88,35.41 163.11,35.41 162.51,34.82 162.51,31.94 167.56,26.9 167.56,10.22 ; 58.19,428.46 62.52,432.79 67.15,432.79 68.58,434.22 68.58,440.61 67.2,441.99 v2(67.2,469.88) ; 445,38.2 447.78,35.42 452.87,35.42 455.4,32.89 455.4,25.28 455.86,24.82 455.86,10.19 ; 371.8,429.24 377.18,434.62 381.8,434.62 382.19,435 382.19,436.07 376.23,442.04 376.23,469.92 ; 176.41,439.25 176.41,440.97 ; 176.41,439.25 176.4,442.76 172.9,446.26 170.14,446.26 168.08,448.32 168.08,467.94 166.7,469.31 166.7,469.87 ; 373.58,428.5 377.91,432.84 382.54,432.84 383.97,434.27 383.97,440.66 382.6,442.04 382.6,469.92 ; U6.53 407.92,51.71 406.31,50.1 406.31,40.85 ; 325.25,10.22 325.25,26.9 320.2,31.94 320.2,34.82 320.79,35.41 323.56,35.41 328.56,40.41 ; 328.55,40.41 328.55,48.17 332.09,51.71 332.09,52.21 ; 444.29,37.91 444.29,50.74 443.33,51.71 U6.77 ; v2(375.74,10.19) 375.74,24.82 376.2,25.28 376.2,32.74 373.87,35.06 368.79,35.06 365.8,38.05 ; 174.97,442.17 172.31,444.83 169.55,444.83 166.66,447.73 166.66,464.27 161.61,469.31 161.61,469.87 ; 368.3,39.09 368.3,47.52 372.48,51.71 372.48,52.21 ; v2(241.75,469.85) 241.75,469.29 245.88,465.16 245.88,447.85 248.56,445.16 251.32,445.16 254.2,442.29 ; v2(384.66,10.19) 384.66,24.82 378.69,30.79 378.69,33.77 374.91,37.56 369.83,37.56 368.29,39.09 ; 451.71,428.79 451.71,410.82 449.45,408.56 449.45,408.06 ; 88.46,41.87 88.47,41.88 ; 298.6,469.88 298.6,441.99 303.65,436.94 303.65,434.81 303.05,434.21 298.43,434.21 293.26,429.05 ; 292.9,429.19 292.9,412.71 288.72,408.52 v1(288.72,408.02) ; 126.97,52.21 126.97,51.71 128.58,50.1 128.58,37.76 ; v2(77.39,469.88) 77.39,441.99 71.42,436.02 71.42,433.04 68.33,429.94 63.7,429.94 61.03,427.28 ; 406.32,40.85 401.95,36.48 399.18,36.48 397.96,35.26 397.96,29.19 400.25,26.9 v2(400.25,10.22) ; 96.56,52.21 96.56,51.71 92.38,47.52 92.38,40.26 ; 287.69,38.35 287.69,50.74 288.66,51.71 U4.83 ; 445,38.2 445,51.39 445.33,51.71 U6.81 ; v2(224.88,469.88) 224.88,441.99 226.26,440.61 226.26,434.22 224.83,432.79 220.2,432.79 215.87,428.46 ; 293.61,428.9 293.61,411.42 290.72,408.52 v1(290.72,408.02) ; 333.38,442.44 333.38,410.78 331.12,408.52 331.12,408.02 ; 296.91,10.19 296.91,24.82 297.37,25.28 297.37,32.74 295.05,35.06 289.97,35.06 286.98,38.05 ; 311.34,469.88 311.34,441.99 307.21,437.86 307.21,433.34 304.53,430.65 299.9,430.65 296.82,427.57 ; 258.12,439.22 258.12,440.94 ; 258.12,439.22 258.11,443.91 252.94,449.08 250.19,449.08 249.8,449.47 249.8,463.32 255.76,469.29 v2(255.76,469.85) ; 459.45,408.06 459.45,408.56 455.26,412.75 455.26,427.32 ; v1(133.97,52.21) 133.97,51.71 131.07,48.81 131.07,38.79 ; U5.77 375.61,408.57 374.65,409.53 374.65,428.06 ; 132.97,52.21 132.97,51.71 130.72,49.45 130.72,38.64 ; 364.02,37.32 364.02,48.17 360.48,51.71 v1(360.48,52.21) ; 374.65,428.06 378.36,431.77 382.98,431.77 385.04,433.82 385.04,440.66 386.42,442.04 386.42,469.92 ; 326.78,41.15 322.83,37.19 320.06,37.19 318.42,35.55 318.42,27.36 318.88,26.9 318.88,10.22 ; v2(51.47,10.19) 51.47,24.82 58.23,31.58 58.23,31.83 57.49,32.57 52.41,32.57 47.96,37.02 47.96,46.88 43.13,51.71 v1(43.13,52.21) ; v1(51.22,408.02) 51.22,408.52 56.05,413.35 56.05,429.34 ; 253.84,442.14 251.17,444.81 248.42,444.81 245.52,447.7 245.52,464.24 240.48,469.29 v2(240.48,469.85) ; 455.62,427.17 455.62,413.39 460.45,408.56 460.45,408.06 ; 169.1,41.15 165.14,37.19 162.37,37.19 160.73,35.55 160.73,27.36 161.19,26.9 161.19,10.22 ; 207.07,37.59 207.07,49.43 204.81,51.68 204.81,52.19 ; 286.98,38.05 286.98,51.39 286.66,51.71 U4.79 ; v1(251.31,408.02) 251.31,408.52 254.21,411.42 254.21,442.29 ; U1.51 293.72,408.52 294.68,409.49 294.68,428.46 ; 328.24,469.84 v2(328.21,469.87) ; v2(393.88,10.22) 393.88,26.9 396.18,29.19 396.18,36 398.44,38.26 401.21,38.26 404.53,41.58 ; v2(60.83,469.88) 60.83,441.99 66.8,436.02 66.8,434.96 66.41,434.57 61.78,434.57 56.41,429.19 ; 98.3,439.22 98.3,440.94 ; 98.3,439.22 98.29,443.03 94.38,446.94 91.62,446.94 89.98,448.58 89.98,468.83 90.44,469.29 v2(90.44,469.85) ; 407.1,469.81 v2(407.07,469.85) ; 446.07,38.64 448.23,36.49 453.31,36.49 456.47,33.33 456.47,28.03 459.68,24.82 459.68,10.19 ; 135.03,408.04 135.03,408.55 136.64,410.16 136.64,428.63 ; v2(218.51,469.88) 218.51,441.99 224.48,436.02 224.48,434.96 224.09,434.57 219.46,434.57 214.09,429.19 ; 136.68,10.19 136.68,24.82 138.98,27.12 138.98,32.44 137.07,34.35 131.99,34.35 128.58,37.76 ; 254.55,442.44 251.47,445.52 248.71,445.52 246.24,447.99 246.24,466.08 243.02,469.29 v2(243.02,469.85) ; 249.25,52.19 249.25,51.68 248.28,50.72 248.28,40.97 ; 387.69,469.92 387.69,442.04 385.4,439.74 385.4,433.68 383.13,431.41 378.5,431.41 375.01,427.91 ; v2(231.25,469.88) 231.25,441.99 228.04,438.78 228.04,433.48 225.57,431.01 220.94,431.01 217.65,427.72 ; U1.87 252.31,408.52 254.56,410.78 254.56,442.44 ; 404.53,41.58 404.54,41.59 ; U6.69 439.33,51.71 442.87,48.17 442.87,37.32 ; v2(226.16,469.88) 226.16,441.99 226.62,441.53 226.62,434.07 224.98,432.43 220.35,432.43 216.22,428.31 ; 405.61,41.15 401.65,37.19 398.88,37.19 397.24,35.55 397.24,27.36 397.7,26.9 v2(397.7,10.22) ; 131.79,39.09 131.79,47.52 135.97,51.71 v1(135.97,52.21) ; v2(379.56,10.19) 379.56,24.82 377.27,27.12 377.27,33.18 374.32,36.13 369.24,36.13 366.87,38.5 ; 137.35,428.34 137.35,408.87 137.03,408.55 137.03,408.04 ; 447.14,39.09 448.67,37.56 453.75,37.56 457.53,33.77 457.53,30.79 463.5,24.82 463.5,10.19 ; 92.56,52.21 92.56,51.71 90.95,50.1 90.95,40.85 ; 58.18,428.46 58.18,409.49 57.22,408.52 U2.115 ; 169.44,41 169.44,50.74 170.41,51.71 170.41,52.21 ; 326.41,41.29 326.41,51.39 326.09,51.71 326.09,52.21 ; U6.55 408.92,51.71 406.66,49.45 406.66,40.7 ; 140.5,10.19 140.5,24.82 140.04,25.28 140.04,32.89 137.51,35.42 132.43,35.42 129.65,38.2 ; 443.22,37.46 447.05,33.64 452.13,33.64 453.62,32.15 453.62,28.95 449.49,24.82 449.49,10.19 ; U2.113 58.22,408.52 58.54,408.84 58.54,428.31 ; v2(402.8,10.22) 402.8,26.9 398.67,31.03 398.67,34.96 399.47,35.77 402.24,35.77 407.03,40.56 ; 327.48,40.85 327.48,50.1 329.09,51.71 329.09,52.21 ; v1(248.31,408.02) 248.31,408.52 253.14,413.35 253.14,441.85 ; 310.07,469.88 310.07,441.99 306.86,438.78 306.86,433.48 304.38,431.01 299.75,431.01 296.46,427.72